# EasyEDA Pro project FPGA-G1.eprj, schematic Schematic1, sheets 1 to 6 of 10 (continued)
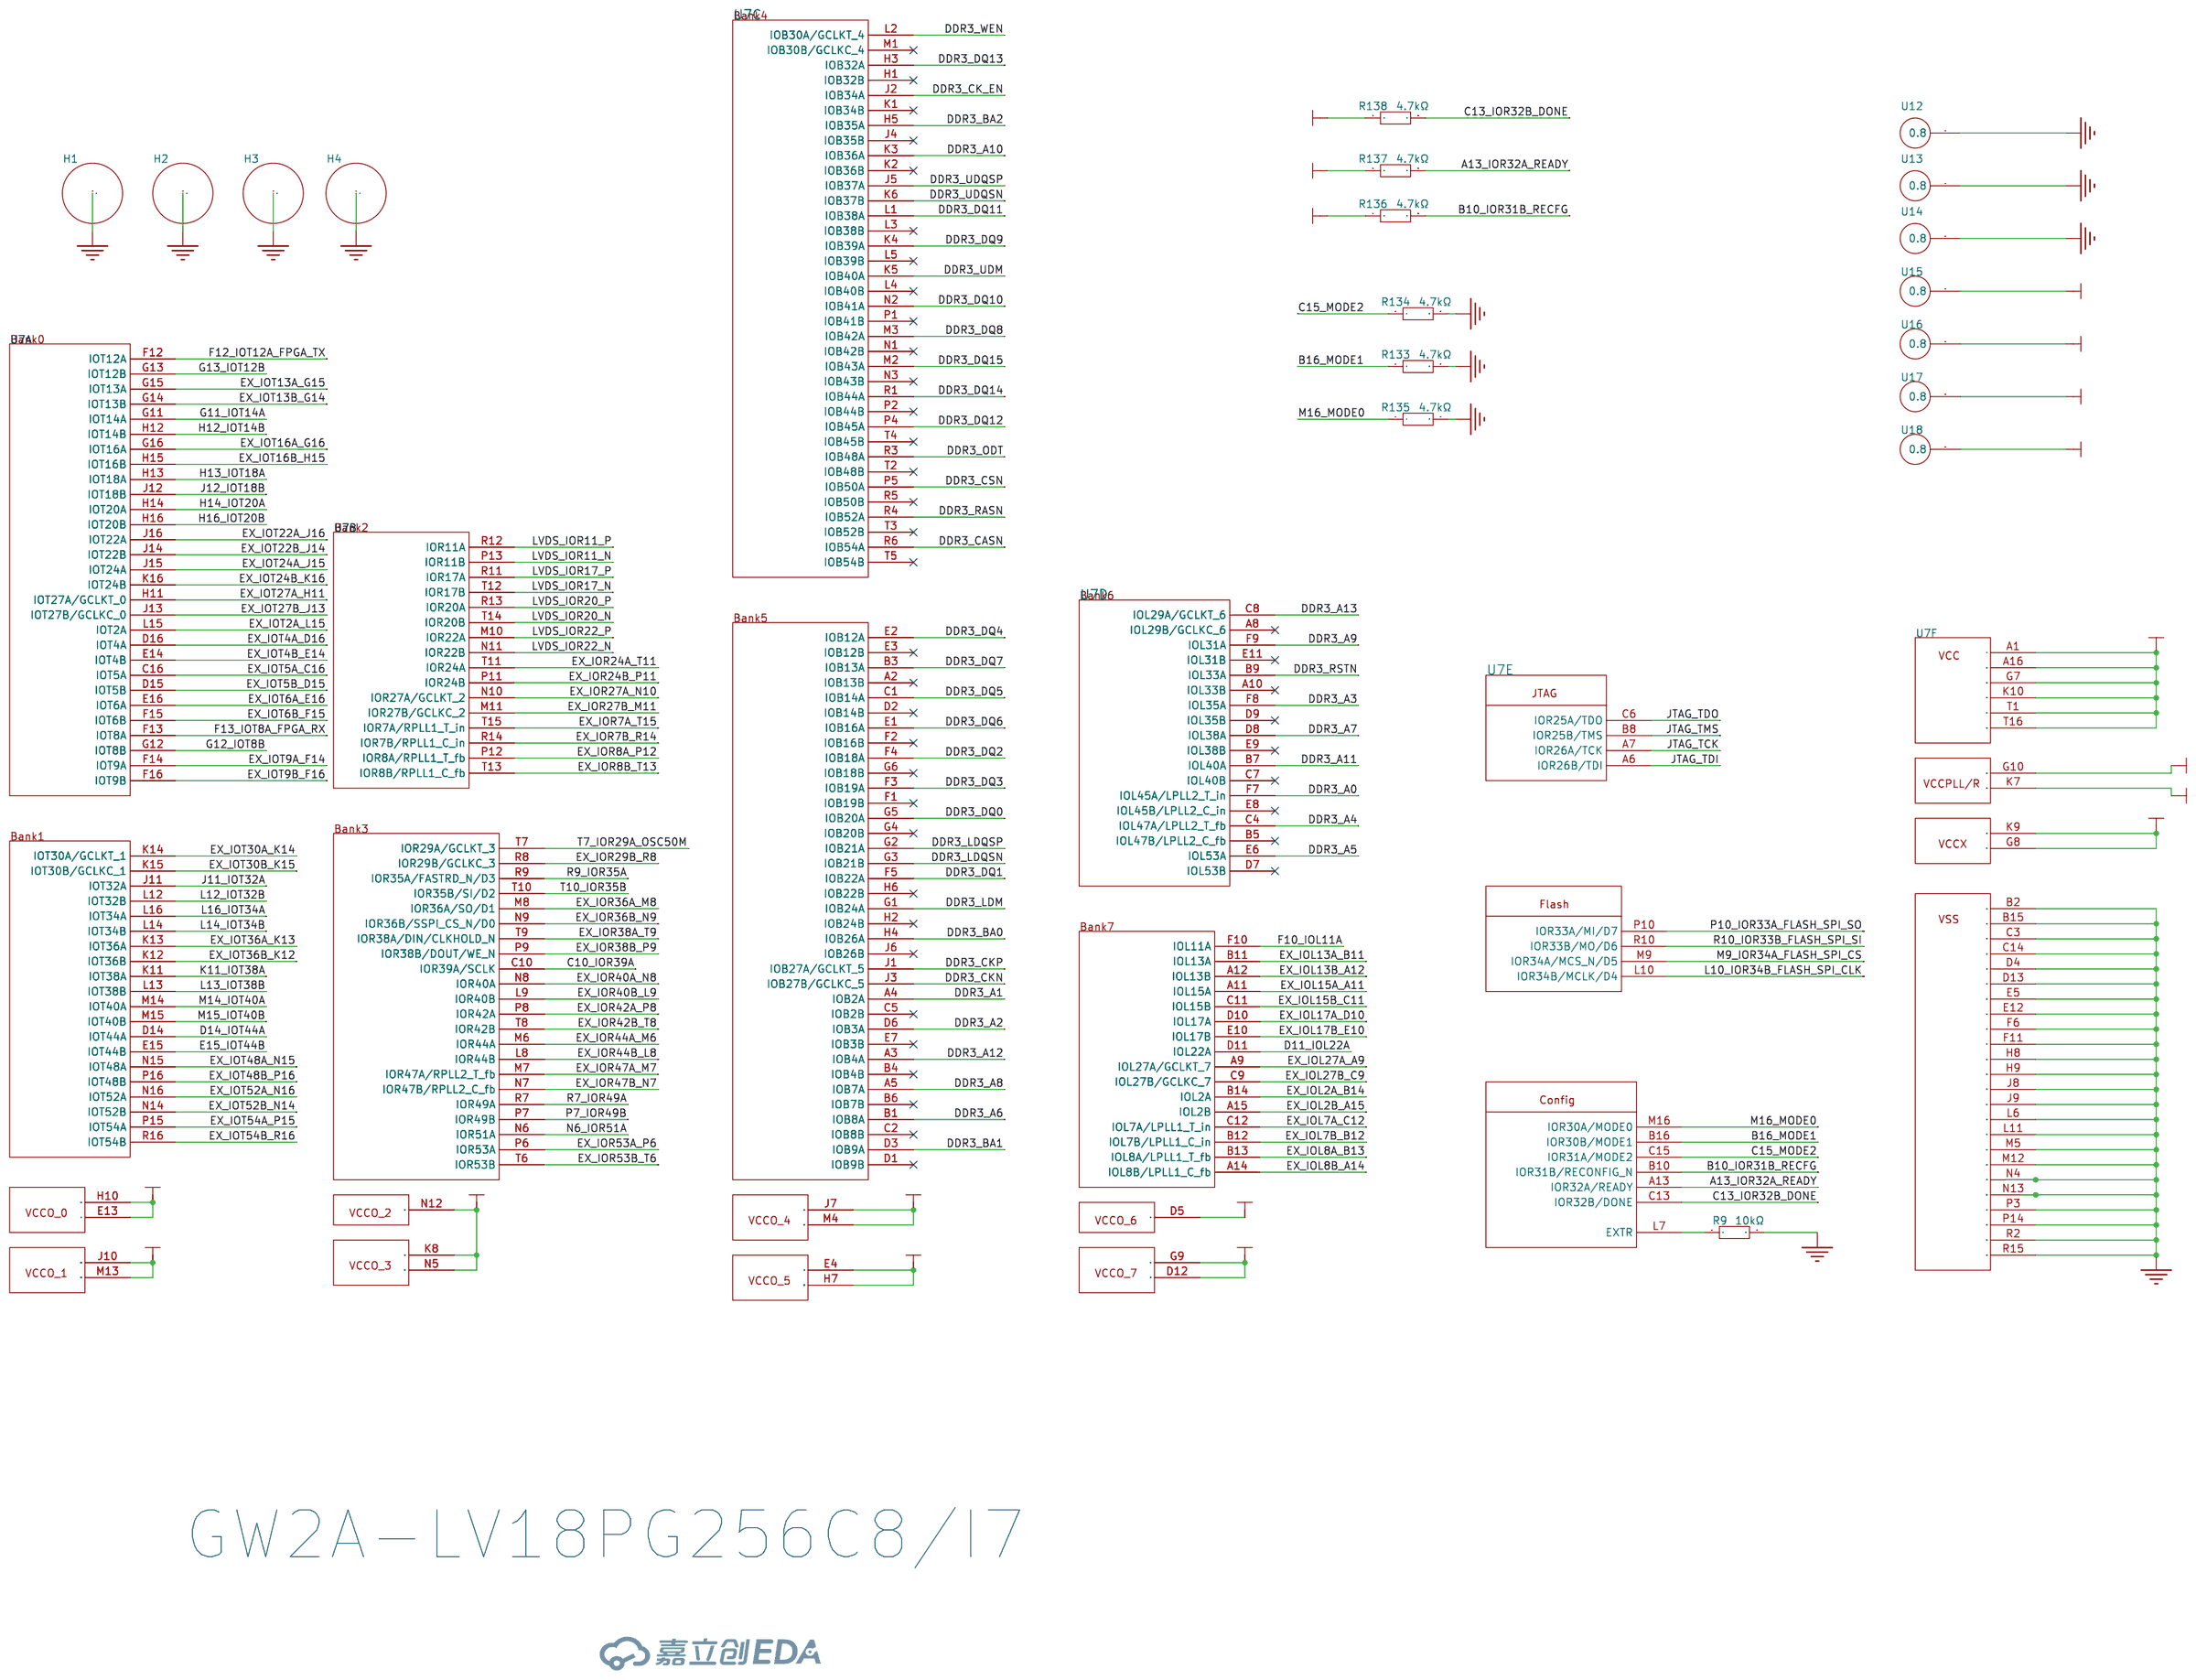
[diagram p0: FPGA]
## Library data of the parts (continued)
RN1 = 4D02WGJ0330TCE: 阻值:33Ω;精度:±5%;单个元件功率:62.5mW;电阻器数:4;温度系数:±200ppm/℃;; LCSC Part Name: 33Ω ±5%; Supplier Part: C25501; Manufacturer: UNI-ROYAL(厚声); Supplier Footprint: 0402x4; JLCPCB Part Class: 扩展库; Datasheet: https://atta.szlcsc.com/upload/public/pdf/source/20191224/C474318_2527498AE30E813171187CCD28401A71.pdf; Supplier: LCSC; Tolerance: ±5%; Power(Watts): 62.5mW; Number of Resistors: 4; Number of Pins: 8; Temperature Coefficient: ±200ppm/℃
TP11-TP16 = Test-Point: Test Point 测试点
U20 = ZX-SH1.0-8PWT: 参考系列:SH;间距:1mm;插针结构:1x8P;排数:1;每排PIN数:8;行距:-;公母:公型插针;安装方式:卧贴;额定电流:1A;触头材质:黄铜;触头镀层:锡;工作温度范围:-25℃~+85℃;焊接温度(最大值):260℃;; LCSC Part Name: 系列:SH 间距:1mm 1x8P 卧贴; Supplier Part: C7430450; Manufacturer: Megastar(兆星); Supplier Footprint: SMD,P=1mm; JLCPCB Part Class: 扩展库; Datasheet: https://atta.szlcsc.com/upload/public/pdf/source/20230619/1B6A23D99AB40A01DBAA7D7AE5A01F3F.pdf; Supplier: LCSC; Reference Series: SH; Pitch: 1mm; Pins Structure: 1x8P; Number of Rows: 1; Number of PINs Per Row: 8; Gender: 公型插针; Mounting Style: 卧贴; Current Rating (Max): 1A; Contact Material: 黄铜; Contact Plating: 锡; Operating Temperature Range: -25℃~+85℃; Welding Temperature (Max): 260℃
U30 = W25Q64JVSSIQ_C83140: 64M-bit/8M-byte FLASH芯片,SPI接口 133MHz(266/532MHz Dual/Quad-SPI) 比W25Q64FVSSIG更高速度; Supplier Part: C83140; Manufacturer: WINBOND(华邦); Supplier Footprint: SOP-8-208mil; JLCPCB Part Class: 扩展库; Datasheet: https://atta.szlcsc.com/upload/public/pdf/source/20161110/1478742546019.pdf; Supplier: LCSC
X3 = OT322550MJBA4SL: 频率:50MHz;工作电压:1.8V~3.3V;频率稳定度:±10ppm;; Supplier: LCSC; Supplier Part: C717684; Manufacturer: YXC(扬兴晶振); JLCPCB Part Class: Extended Part; LCSC Part Name: 50MHz ±10ppm 1.8V~3.3V YSO110TR; Supplier Footprint: SMD3225-4P; Datasheet: https://atta.szlcsc.com/upload/public/pdf/source/20210329/C669065_30B18CFE780D377BA4E84F6ED1951959.pdf; Supply Voltage: 1.8V~3.3V; Frequency Stability: ±10ppm; Operating Temperature: -40℃~+85℃
D6 D7 = 0402ESDA-05N: 极性:双向;反向截止电压(Vrwm):5V;钳位电压(Vc)@Ipp:50V;; LCSC Part Name: 双向ESD; Supplier Part: C316049; Manufacturer: BORN(伯恩半导体); Supplier Footprint: 0402; JLCPCB Part Class: 扩展库; Datasheet: https://atta.szlcsc.com/upload/public/pdf/source/20181026/C316049_37ABAC87650F175221BFB473159300DE.pdf; Supplier: LCSC; Polarity: 双向; Reverse Stand-Off Voltage (Vrwm): 5V; Clamping Voltage@Ipp: 50V
LED2 LED3 = E6C0606RGBC3UDA: 发光颜色:RGB三色;; LCSC Part Name: RGB三色; Supplier Part: C375569; Manufacturer: ekinglux(亿晶源); Supplier Footprint: 0603; JLCPCB Part Class: Extended Part; Datasheet: https://atta.szlcsc.com/upload/public/pdf/source/20220330/8DE12FB9881A833E867FD7AF6894B416.pdf; Supplier: LCSC; Emitted Color: RGB三色
LED6 = SLS0281FR1A1GD: 数码管位数:1;数字/字母大小(英寸):0.28;LED极性:共阳;发光颜色:红色;; LCSC Part Name: 0.28英寸,一位,红光,贴片LED数码管; Supplier Part: C225994; Manufacturer: SUNLIGHT(光华); Supplier Footprint: SMD; JLCPCB Part Class: 扩展库; Datasheet: https://atta.szlcsc.com/upload/public/pdf/source/20180809/C225994_07659105DBFE86D4692F62FAD9EC8625.pdf; Supplier: LCSC; Number of Characters: 1; Digit/Alpha Size(inch): 0.28; LED Polarity: 共阳; Luminous Color: 红色
R170 R173 = 0402WGF3001TCE: 电阻类型:厚膜电阻;阻值:3kΩ;精度:±1%;功率:62.5mW;; LCSC Part Name: 3kΩ ±1% 62.5mW; Supplier Part: C25784; Manufacturer: UNI-ROYAL(厚声); Supplier Footprint: 0402; JLCPCB Part Class: Extended Part; Datasheet: https://atta.szlcsc.com/upload/public/pdf/source/20200306/C422600_1E6D84923E4A46A82E41ADD87F860B5C.pdf; Supplier: LCSC; Type: 厚膜电阻; Tolerance: ±1%; Power(Watts): 62.5mW; Temperature Coefficient: ±100ppm/℃; Overload Voltage (Max): 50V; Operating Temperature Range: -55℃~+155℃
R171 R174 = 0402WGF4301TCE: 电阻类型:厚膜电阻;阻值:4.3kΩ;精度:±1%;功率:62.5mW;最大工作电压:50V;温度系数:±100ppm/℃;; LCSC Part Name: 4.3kΩ ±1% 62.5mW 厚膜电阻; Supplier Part: C25899; Manufacturer: UNI-ROYAL(厚声); Supplier Footprint: 0402; JLCPCB Part Class: 扩展库; Datasheet: https://atta.szlcsc.com/upload/public/pdf/source/20200306/C422600_1E6D84923E4A46A82E41ADD87F860B5C.pdf; Supplier: LCSC; Type: 厚膜电阻; Tolerance: ±1%; Power(Watts): 62.5mW; Overload Voltage (Max): 50V; Temperature Coefficient: ±100ppm/℃; Operating Temperature Range: -55℃~+155℃
R172 R175 = 0402WGF9101TCE: 电阻类型:厚膜电阻;阻值:9.1kΩ;精度:±1%;功率:62.5mW;; LCSC Part Name: 9.1kΩ ±1% 62.5mW; Supplier Part: C25926; Manufacturer: UNI-ROYAL(厚声); Supplier Footprint: 0402; JLCPCB Part Class: Extended Part; Datasheet: https://atta.szlcsc.com/upload/public/pdf/source/20200306/C422600_1E6D84923E4A46A82E41ADD87F860B5C.pdf; Supplier: LCSC; Type: 厚膜电阻; Tolerance: ±1%; Power(Watts): 62.5mW; Temperature Coefficient: ±100ppm/℃; Overload Voltage (Max): 50V; Operating Temperature Range: -55℃~+155℃
RN4 RN5 = 4D02WGJ0511TCE: 阻值:510Ω;精度:±5%;单个元件功率:62.5mW;电阻器数:4;; LCSC Part Name: 510Ω ±5% 0402x4; Supplier Part: C425248; Manufacturer: UNI-ROYAL(厚声); Supplier Footprint: 0402x4; JLCPCB Part Class: 扩展库; Datasheet: https://atta.szlcsc.com/upload/public/pdf/source/20190904/C425248_6D01193C5E209F8AF6334EE5A18B2189.pdf; Supplier: LCSC; Tolerance: ±5%; Power(Watts): 62.5mW; Number of Resistors: 4; Number of Pins: 8; Temperature Coefficient: ±200ppm/℃
SW2 SW3 = PTS815SJK250SMTRLFS: 电路结构:单刀单掷-常开;按钮形状:椭圆形按钮;作用力:250gf;安装方式:立贴;触点电流:50mA;额定电压(DC):12V;; LCSC Part Name: 轻触开关; Supplier Part: C918859; Manufacturer: C&K; Supplier Footprint: SMD; JLCPCB Part Class: Extended Part; Datasheet: https://atta.szlcsc.com/upload/public/pdf/source/20190916/C411883_4F77F16E1D8E48DC707D8949CEE7CF80.pdf; Supplier: LCSC; Circuit: 单刀单掷-常开; Actuator Style: 椭圆形按钮; Operating Force: 250gf; Mounting Style: 立贴; Contact Current: 50mA; Voltage Rating (DC): 12V; IP Rating: IP40; Pin Style: J型引脚; Operating Temperature: -20℃~+70℃

## Nets
+1.0V: U7.A1(1) U7.A16(16) U7.G7(103) U7.K10(154) U7.T1(241) U7.T16(256) U18.1(0.8) ; also on sheet 10
+1.5V: C31.2 C32.2 C33.2 C34.2 C35.2 C96.2 C97.2 C98.2 C99.2 C100.2 C101.2 C102.2 C103.2 C104.2 C105.2 C140.2 C141.2 C142.2 L8.2 U7.D5(53) U7.E4(68) U7.H7(119) U7.J7(135) U7.M4(180) U17.1(0.8) U29.A1(VDDQ) U29.A8(VDDQ) U29.B2(VDD) U29.C1(VDDQ) U29.C9(VDDQ) U29.D2(VDDQ) U29.D9(VDD) U29.E9(VDDQ) U29.F1(VDDQ) U29.G7(VDD) U29.H2(VDDQ) U29.H9(VDDQ) U29.K2(VDD) U29.K8(VDD) U29.N1(VDD) U29.N9(VDD) U29.R1(VDD) U29.R9(VDD) ; also on sheet 10
+3.3V: C57.1 L9.2 L16.1 LED2.2(+) LED3.2(+) LED6.3(COM) LED6.8(COM) R30.1 R31.2 R61.2 R136.1 R137.1 R138.1 R154.2 R155.2 R176.2 R178.2 U7.D12(60) U7.E13(77) U7.G8(104) U7.G9(105) U7.H10(122) U7.J10(138) U7.K8(152) U7.K9(153) U7.M13(189) U7.N5(197) U7.N12(204) U16.1(0.8) U30.8(VCC) ; also on sheet 7 8 9 10
+5V_IN: C21.2 D4.2(A) TP15.1 U15.1(0.8) U20.8 ; also on sheet 7 8 10
GND: C21.1 C23.2 C31.1 C32.1 C33.1 C34.1 C35.1 C56.1 C57.2 C68.2 C69.1 C72.2 C73.2 C74.2 C75.1 C76.1 C77.2 C81.1 C82.1 C83.1 C84.2 C85.2 C88.2 C89.2 C96.1 C97.1 C98.1 C99.1 C100.1 C101.1 C102.1 C103.1 C104.1 C105.1 C119.1 C134.1 C135.1 C136.1 C137.2 C138.2 C139.2 C140.1 C141.1 C142.1 D6.1 D7.1 D9.3(GND) D9.8(GND) D10.3(GND) D10.8(GND) H1.1 H2.1 H3.1 H4.1 LED4.1(K) R9.2 R20.1 R76.1 R109.1 R130.1 R131.1 R132.1 R133.2 R134.2 R135.2 R151.1 SW2.3 SW2.4 SW3.3 SW3.4 TP16.1 U7.B2(18) U7.B15(31) U7.C3(35) U7.C14(46) U7.D4(52) U7.D13(61) U7.E5(69) U7.E12(76) U7.F6(86) U7.F11(91) U7.H8(120) U7.H9(121) U7.J8(136) U7.J9(137) U7.L6(166) U7.L11(171) U7.M5(181) U7.M12(188) U7.N4(196) U7.N13(205) U7.P3(211) U7.P14(222) U7.R2(226) U7.R15(239) U12.1(0.8) U13.1(0.8) U14.1(0.8) U20.1 U20.9 U20.10 U23.4(PGND) U23.8(GND) U23.11(EPAD) U29.A9(VSS) U29.B1(VSSQ) U29.B3(VSS) U29.B9(VSSQ) U29.D1(VSSQ) U29.D8(VSSQ) U29.E1(VSS) U29.E2(VSSQ) U29.E8(VSSQ) U29.F9(VSSQ) U29.G1(VSSQ) U29.G8(VSS) U29.G9(VSSQ) U29.J2(VSS) U29.J8(VSS) U29.M1(VSS) U29.M9(VSS) U29.P1(VSS) U29.P9(VSS) U29.T1(VSS) U29.T9(VSS) U30.4(GND) USB3.4(TMDS_DATA2_SHIELD) USB3.7(TMDS_DATA1_SHIELD) USB3.10(TMDS_DATA0_SHIELD) USB3.13(TMDS_CLOCK_SHIELD) USB3.16(DDC/CEC_GND) USB3.20(SHIELD) X3.2(GND) ; also on sheet 7 8 9 10
VCCPLLL: U7.G10(106) ; also on sheet 10
VCCPLLR: U7.K7(151) ; also on sheet 10
A6_IOR26B_JTAG_TDI: RN1.4 TP14.1 U20.4
A7_IOR26A_JTAG_TCK: R20.2 RN1.3 TP13.1 U20.5
A13_IOR32A_READY: R137.2 U7.A13(IOR32A/READY)
B8_IOR25B_JTAG_TMS: RN1.1 TP11.1 U20.7
B10_IOR31B_RECFG: R136.2 U7.B10(IOR31B/RECONFIG_N)
B16_MODE1: R133.1 U7.B16(IOR30B/MODE1)
C6_IOR25A_JTAG_TDO: RN1.2 TP12.1 U20.6
C10_IOR39A: R172.2 U7.C10(IOR39A/SCLK)
C13_IOR32B_DONE: R138.2 U7.C13(IOR32B/DONE)
C15_MODE2: R134.1 U7.C15(IOR31A/MODE2)
D11_IOL22A: C72.1 D6.2 R61.1 SW2.1 SW2.2 U7.D11(IOL22A)
D14_IOT44A: U7.D14(IOT44A) ; also on sheet 7
DDR3_A0: R123.2 U7.F7(IOL45A/LPLL2_T_in) U29.N3(A0)
DDR3_A1: R122.2 U7.A4(IOB2A) U29.P7(A1)
DDR3_A2: R121.2 U7.D6(IOB3A) U29.P3(A2)
DDR3_A3: R120.2 U7.F8(IOL35A) U29.N2(A3)
DDR3_A4: R119.1 U7.C4(IOL47A/LPLL2_T_fb) U29.P8(A4)
DDR3_A5: R118.1 U7.E6(IOL53A) U29.P2(A5)
DDR3_A6: R117.1 U7.B1(IOB8A) U29.R8(A6)
DDR3_A7: R116.1 U7.D8(IOL38A) U29.R2(A7)
DDR3_A8: R115.1 U7.A5(IOB7A) U29.T8(A8)
DDR3_A9: R114.1 U7.F9(IOL31A) U29.R3(A9)
DDR3_A10: R113.1 U7.K3(IOB36A) U29.L7(A10/AP)
DDR3_A11: R112.1 U7.B7(IOL40A) U29.R7(A11)
DDR3_A12: R111.1 U7.A3(IOB4A) U29.N7(A12/BC#)
DDR3_A13: R110.1 U7.C8(IOL29A/GCLKT_6) U29.T3(A13)
DDR3_BA0: R126.2 U7.H4(IOB26A) U29.M2(BA0)
DDR3_BA1: R125.2 U7.D3(IOB9A) U29.N8(BA1)
DDR3_BA2: R124.2 U7.H5(IOB35A) U29.M3(BA2)
DDR3_CASN: R127.1 U7.R6(IOB54A) U29.K3(CAS#)
DDR3_CK_EN: R131.2 U7.J2(IOB34A) U29.K9(CKE)
DDR3_CKN: R106.2 U7.J3(IOB27B/GCLKC_5) U29.K7(CK#)
DDR3_CKP: R106.1 U7.J1(IOB27A/GCLKT_5) U29.J7(CK)
DDR3_CSN: R130.2 U7.P5(IOB50A) U29.L2(CS#)
DDR3_DQ0: U7.G5(IOB20A) U29.E3(DQ0)
DDR3_DQ1: U7.F5(IOB22A) U29.F7(DQ1)
DDR3_DQ2: U7.F4(IOB18A) U29.F2(DQ2)
DDR3_DQ3: U7.F3(IOB19A) U29.F8(DQ3)
DDR3_DQ4: U7.E2(IOB12A) U29.H3(DQ4)
DDR3_DQ5: U7.C1(IOB14A) U29.H8(DQ5)
DDR3_DQ6: U7.E1(IOB16A) U29.G2(DQ6)
DDR3_DQ7: U7.B3(IOB13A) U29.H7(DQ7)
DDR3_DQ8: U7.M3(IOB42A) U29.D7(DQ8)
DDR3_DQ9: U7.K4(IOB39A) U29.C3(DQ9)
DDR3_DQ10: U7.N2(IOB41A) U29.C8(DQ10)
DDR3_DQ11: U7.L1(IOB38A) U29.C2(DQ11)
DDR3_DQ12: U7.P4(IOB45A) U29.A7(DQ12)
DDR3_DQ13: U7.H3(IOB32A) U29.A2(DQ13)
DDR3_DQ14: U7.R1(IOB44A) U29.B8(DQ14)
DDR3_DQ15: U7.M2(IOB43A) U29.A3(DQ15)
DDR3_LDM: U7.G1(IOB24A) U29.E7(LDM)
DDR3_LDQSN: U7.G3(IOB21B) U29.G3(LDQS#)
DDR3_LDQSP: U7.G2(IOB21A) U29.F3(LDQS)
DDR3_ODT: U7.R3(IOB48A) U29.K1(ODT)
DDR3_RASN: R128.1 U7.R4(IOB52A) U29.J3(RAS#)
DDR3_RSTN: R109.2 U7.B9(IOL33A) U29.T2(RESET#)
DDR3_UDM: U7.K5(IOB40A) U29.D3(UDM)
DDR3_UDQSN: U7.K6(IOB37B) U29.B7(UDQS#)
DDR3_UDQSP: U7.J5(IOB37A) U29.C7(UDQS)
DDR3_WEN: R129.1 U7.L2(IOB30A/GCLKT_4) U29.L3(WE#)
E15_IOT44B: U7.E15(IOT44B) ; also on sheet 7
EX_IOL2A_B14: U7.B14(IOL2A) ; also on sheet 8
EX_IOL2B_A15: U7.A15(IOL2B) ; also on sheet 8
EX_IOL7A_C12: U7.C12(IOL7A/LPLL1_T_in) ; also on sheet 8
EX_IOL7B_B12: U7.B12(IOL7B/LPLL1_C_in) ; also on sheet 8
EX_IOL8A_B13: U7.B13(IOL8A/LPLL1_T_fb) ; also on sheet 8
EX_IOL8B_A14: U7.A14(IOL8B/LPLL1_C_fb) ; also on sheet 8
EX_IOL13A_B11: U7.B11(IOL13A) ; also on sheet 8
EX_IOL13B_A12: U7.A12(IOL13B) ; also on sheet 8
EX_IOL15A_A11: U7.A11(IOL15A) ; also on sheet 8
EX_IOL15B_C11: U7.C11(IOL15B) ; also on sheet 8
EX_IOL17A_D10: U7.D10(IOL17A) ; also on sheet 8
EX_IOL17B_E10: U7.E10(IOL17B) ; also on sheet 8
EX_IOL27A_A9: U7.A9(IOL27A/GCLKT_7) ; also on sheet 8
EX_IOL27B_C9: U7.C9(IOL27B/GCLKC_7) ; also on sheet 8
EX_IOR7A_T15: U7.T15(IOR7A/RPLL1_T_in) ; also on sheet 8
EX_IOR7B_R14: U7.R14(IOR7B/RPLL1_C_in) ; also on sheet 8
EX_IOR8A_P12: U7.P12(IOR8A/RPLL1_T_fb) ; also on sheet 8
EX_IOR8B_T13: U7.T13(IOR8B/RPLL1_C_fb) ; also on sheet 8
EX_IOR24A_T11: U7.T11(IOR24A) ; also on sheet 8
EX_IOR24B_P11: U7.P11(IOR24B) ; also on sheet 8
EX_IOR27A_N10: U7.N10(IOR27A/GCLKT_2) ; also on sheet 8
EX_IOR27B_M11: U7.M11(IOR27B/GCLKC_2) ; also on sheet 8
EX_IOR29B_R8: U7.R8(IOR29B/GCLKC_3) ; also on sheet 8
EX_IOR36A_M8: U7.M8(IOR36A/SO/D1) ; also on sheet 8
EX_IOR36B_N9: U7.N9(IOR36B/SSPI_CS_N/D0) ; also on sheet 8
EX_IOR38A_T9: U7.T9(IOR38A/DIN/CLKHOLD_N) ; also on sheet 8
EX_IOR38B_P9: U7.P9(IOR38B/DOUT/WE_N) ; also on sheet 8
EX_IOR40A_N8: U7.N8(IOR40A) ; also on sheet 8
EX_IOR40B_L9: U7.L9(IOR40B) ; also on sheet 8
EX_IOR42A_P8: U7.P8(IOR42A) ; also on sheet 8
EX_IOR42B_T8: U7.T8(IOR42B) ; also on sheet 8
EX_IOR44A_M6: U7.M6(IOR44A) ; also on sheet 8
EX_IOR44B_L8: U7.L8(IOR44B) ; also on sheet 8
EX_IOR47A_M7: U7.M7(IOR47A/RPLL2_T_fb) ; also on sheet 8
EX_IOR47B_N7: U7.N7(IOR47B/RPLL2_C_fb) ; also on sheet 8
EX_IOR53A_P6: U7.P6(IOR53A) ; also on sheet 8
EX_IOR53B_T6: U7.T6(IOR53B) ; also on sheet 8
EX_IOT2A_L15: U7.L15(IOT2A) ; also on sheet 10
EX_IOT4A_D16: U7.D16(IOT4A) ; also on sheet 8
EX_IOT4B_E14: U7.E14(IOT4B) ; also on sheet 8
EX_IOT5A_C16: U7.C16(IOT5A) ; also on sheet 8
EX_IOT5B_D15: U7.D15(IOT5B) ; also on sheet 8
EX_IOT6A_E16: U7.E16(IOT6A) ; also on sheet 8
EX_IOT6B_F15: U7.F15(IOT6B) ; also on sheet 8
EX_IOT9A_F14: U7.F14(IOT9A) ; also on sheet 8
EX_IOT9B_F16: U7.F16(IOT9B) ; also on sheet 8
EX_IOT13A_G15: U7.G15(IOT13A) ; also on sheet 8
EX_IOT13B_G14: U7.G14(IOT13B) ; also on sheet 8
EX_IOT16A_G16: U7.G16(IOT16A) ; also on sheet 8
EX_IOT16B_H15: U7.H15(IOT16B) ; also on sheet 8
EX_IOT22A_J16: U7.J16(IOT22A) ; also on sheet 8
EX_IOT22B_J14: U7.J14(IOT22B) ; also on sheet 8
EX_IOT24A_J15: U7.J15(IOT24A) ; also on sheet 8
EX_IOT24B_K16: U7.K16(IOT24B) ; also on sheet 8
EX_IOT27A_H11: U7.H11(IOT27A/GCLKT_0) ; also on sheet 8
EX_IOT27B_J13: U7.J13(IOT27B/GCLKC_0) ; also on sheet 8
EX_IOT30A_K14: U7.K14(IOT30A/GCLKT_1) ; also on sheet 8
EX_IOT30B_K15: U7.K15(IOT30B/GCLKC_1) ; also on sheet 8
EX_IOT36A_K13: U7.K13(IOT36A) ; also on sheet 8
EX_IOT36B_K12: U7.K12(IOT36B) ; also on sheet 8
EX_IOT48A_N15: U7.N15(IOT48A) ; also on sheet 8
EX_IOT48B_P16: U7.P16(IOT48B) ; also on sheet 8
EX_IOT52A_N16: U7.N16(IOT52A) ; also on sheet 8
EX_IOT52B_N14: U7.N14(IOT52B) ; also on sheet 8
EX_IOT54A_P15: U7.P15(IOT54A) ; also on sheet 8
EX_IOT54B_R16: U7.R16(IOT54B) ; also on sheet 8
F10_IOL11A: C73.1 D7.2 R178.1 SW3.1 SW3.2 U7.F10(IOL11A)
F12_IOT12A_FPGA_TX: R18.2 U7.F12(IOT12A)
F13_IOT8A_FPGA_RX: R19.2 U7.F13(IOT8A)
G11_IOT14A: RN4.4 U7.G11(IOT14A)
G12_IOT8B: RN4.3 U7.G12(IOT8B)
G13_IOT12B: RN4.2 U7.G13(IOT12B)
H12_IOT14B: RN5.7 U7.H12(IOT14B)
H13_IOT18A: RN5.6 U7.H13(IOT18A)
H14_IOT20A: RN5.5 U7.H14(IOT20A)
H16_IOT20B: RN4.1 U7.H16(IOT20B)
HDMI_5V: C68.1 C69.2 D4.1(K) R152.2 R153.2 USB3.19(+5V)
HDMI_CLK_N: D10.5(I/O4) D10.6(NC) R150.1 USB3.14(TMDS_CLOCK-)
HDMI_CLK_P: D10.4(I/O3) D10.7(NC) R149.1 USB3.12(TMDS_CLOCK+)
HDMI_DATA0_N: D10.2(I/O2) D10.9(NC) R148.1 USB3.11(TMDS_DATA0-)
HDMI_DATA0_P: D10.1(I/O1) D10.10(NC) R147.1 USB3.9(TMDS_DATA0+)
HDMI_DATA1_N: D9.5(I/O4) D9.6(NC) R146.1 USB3.8(TMDS_DATA1-)
HDMI_DATA1_P: D9.4(I/O3) D9.7(NC) R145.1 USB3.6(TMDS_DATA1+)
HDMI_DATA2_N: D9.2(I/O2) D9.9(NC) R144.1 USB3.5(TMDS_DATA2-)
HDMI_DATA2_P: D9.1(I/O1) D9.10(NC) R143.1 USB3.3(TMDS_DATA2+)
J11_IOT32A: U7.J11(IOT32A) ; also on sheet 7
J12_IOT18B: U7.J12(IOT18B) ; also on sheet 7
JTAG_TCK: RN1.6 U7.A7(IOR26A/TCK)
JTAG_TDI: RN1.5 U7.A6(IOR26B/TDI)
JTAG_TDO: RN1.7 U7.C6(IOR25A/TDO)
JTAG_TMS: RN1.8 U7.B8(IOR25B/TMS)
K11_IOT38A: U7.K11(IOT38A) ; also on sheet 7
L10_IOR34B_FLASH_SPI_CLK: R151.2 U7.L10(IOR34B/MCLK/D4) U30.6(CLK)
L12_IOT32B: U7.L12(IOT32B) ; also on sheet 7
L13_IOT38B: U7.L13(IOT38B) ; also on sheet 7
L14_IOT34B: RN5.8 U7.L14(IOT34B)
L16_IOT34A: U7.L16(IOT34A) ; also on sheet 7
LVDS_IOR11_N: R144.2 U7.P13(IOR11B)
LVDS_IOR11_P: R143.2 U7.R12(IOR11A)
LVDS_IOR17_N: R146.2 U7.T12(IOR17B)
LVDS_IOR17_P: R145.2 U7.R11(IOR17A)
LVDS_IOR20_N: R148.2 U7.T14(IOR20B)
LVDS_IOR20_P: R147.2 U7.R13(IOR20A)
LVDS_IOR22_N: R150.2 U7.N11(IOR22B)
LVDS_IOR22_P: R149.2 U7.M10(IOR22A)
M9_IOR34A_FLASH_SPI_CS: U7.M9(IOR34A/MCS_N/D5) U30.1(CS#)
M14_IOT40A: U7.M14(IOT40A) ; also on sheet 10
M15_IOT40B: U7.M15(IOT40B) ; also on sheet 10
M16_MODE0: R135.1 U7.M16(IOR30A/MODE0)
N6_IOR51A: R173.1 U7.N6(IOR51A)
P7_IOR49B: R174.2 U7.P7(IOR49B)
P10_IOR33A_FLASH_SPI_SO: U7.P10(IOR33A/MI/D7) U30.2(DO)
R7_IOR49A: R171.2 U7.R7(IOR49A)
R9_IOR35A: R170.1 U7.R9(IOR35A/FASTRD_N/D3)
R10_IOR33B_FLASH_SPI_SI: U7.R10(IOR33B/MO/D6) U30.5(DI)
T7_IOR29A_OSC50M: R17.2 U7.T7(IOR29A/GCLKT_3)
T10_IOR35B: R175.2 U7.T10(IOR35B/SI/D2)
VREF_DRAM: C77.1 C88.1 C89.1 U23.6(REFOUT) U29.H1(VREFDQ) U29.M8(VREFCA)
VTT_DRAM: C23.1 C81.2 C82.2 C83.2 C84.1 C85.1 C134.2 C135.2 C136.2 C137.1 C138.1 C139.1 R110.2 R111.2 R112.2 R113.2 R114.2 R115.2 R116.2 R117.2 R118.2 R119.2 R120.1 R121.1 R122.1 R123.1 R124.1 R125.1 R126.1 R127.2 R128.2 R129.2 U23.3(VO) U23.5(VOSNS)
$1N2157: R9.1 U7.L7(EXTR)
$2N2162: R132.2 U29.L8(ZQ)
$3N1163: C75.2 C76.2 L8.1 R75.2 U23.2(VLDOIN)
$3N1169: C119.2 R75.1 R76.2 U23.1(REFIN)
$3N1170: R74.2 U23.9(PGOOD)
$3N1171: R73.2 U23.7(EN)
$3N1172: C74.1 L9.1 R73.1 R74.1 U23.10(VIN)
$4N1091: R18.1 U20.3
$4N1092: R19.1 U20.2
$4N1100: R17.1 X3.3(OUTPUT)
$4N1105: R31.1 U30.3(IO2)
$4N1112: R30.2 U30.7(IO3)
$4N1119: C56.2 L16.2 X3.1(TRI) X3.4(VDD)
$4N1123: LED4.2(A) R176.1
$5N1099: R152.1 USB3.18(SDA)
$5N1100: R153.1 USB3.17(SCL)
$5N1108: R155.1 USB3.1(HOT_PLUG_DET)
$5N1109: R154.1 USB3.15(CEC)
$6N914: LED6.6(B) RN4.8
$6N915: LED6.7(A) RN4.7
$6N916: LED6.9(F) RN4.6
$6N917: LED6.10(G) RN4.5
$6N918: LED6.5(DP) RN5.1
$6N919: LED6.4(C) RN5.2
$6N920: LED6.2(D) RN5.3
$6N921: LED6.1(E) RN5.4
$6N938: LED2.4(-) R170.2
$6N939: LED2.1(-) R171.1
$6N940: LED2.3(-) R172.1
$6N948: LED3.4(-) R173.2
$6N949: LED3.1(-) R174.1
$6N950: LED3.3(-) R175.1

Not connected (* = marked no-connect by the designer): U7 A2(IOB13B)* A8(IOL29B/GCLKC_6)* A10(IOL33B)* B4(IOB4B)* B5(IOL47B/LPLL2_C_fb)* B6(IOB7B)* C2(IOB8B)* C5(IOB2B)* C7(IOL40B)* D1(IOB9B)* D2(IOB14B)* D7(IOL53B)* D9(IOL35B)* E3(IOB12B)* E7(IOB3B)* E8(IOL45B/LPLL2_C_in)* E9(IOL38B)* E11(IOL31B)* F1(IOB19B)* F2(IOB16B)* G4(IOB20B)* G6(IOB18B)* H1(IOB32B)* H2(IOB24B)* H6(IOB22B)* J4(IOB35B)* J6(IOB26B)* K1(IOB34B)* K2(IOB36B)* L3(IOB38B)* L4(IOB40B)* L5(IOB39B)* M1(IOB30B/GCLKC_4)* N1(IOB42B)* N3(IOB43B)* P1(IOB41B)* P2(IOB44B)* R5(IOB50B)* T2(IOB48B)* T3(IOB52B)* T4(IOB45B)* T5(IOB54B)*; U29 J1(NC)* J9(NC)* L1(NC)* L9(NC)* M7(NC)* T7(NC)*; USB3 2(UTILITY)*

## Notes on the sheets
sheet 1
- GW2A-LV18PG256C8/I7
sheet 2
- DDR3
sheet 3
- 线性终端稳压器
sheet 4
- JTAG下载接口
- Power 指示灯
- 晶振电路
- SPI-NORFLASH
sheet 5
- HDMI 接口
sheet 6
- 红
- 绿
- 蓝
- 红
- 绿
- 蓝
- LED&&按键&&数码管
